# EasyEDA Pro project YanQi_Project.eprj, schematic PayloadBoard

## Sheets
1 电调主控: Create Date: 2023-04-20; Page Name: 电调主控; Project Name: YanXi_Project; Schematic Name: PayloadBoard; Update Date: 2023-08-07; Company: 嘉立创EDA; Drawed: WANG BIN; Page Size: A4; Version: V1.0
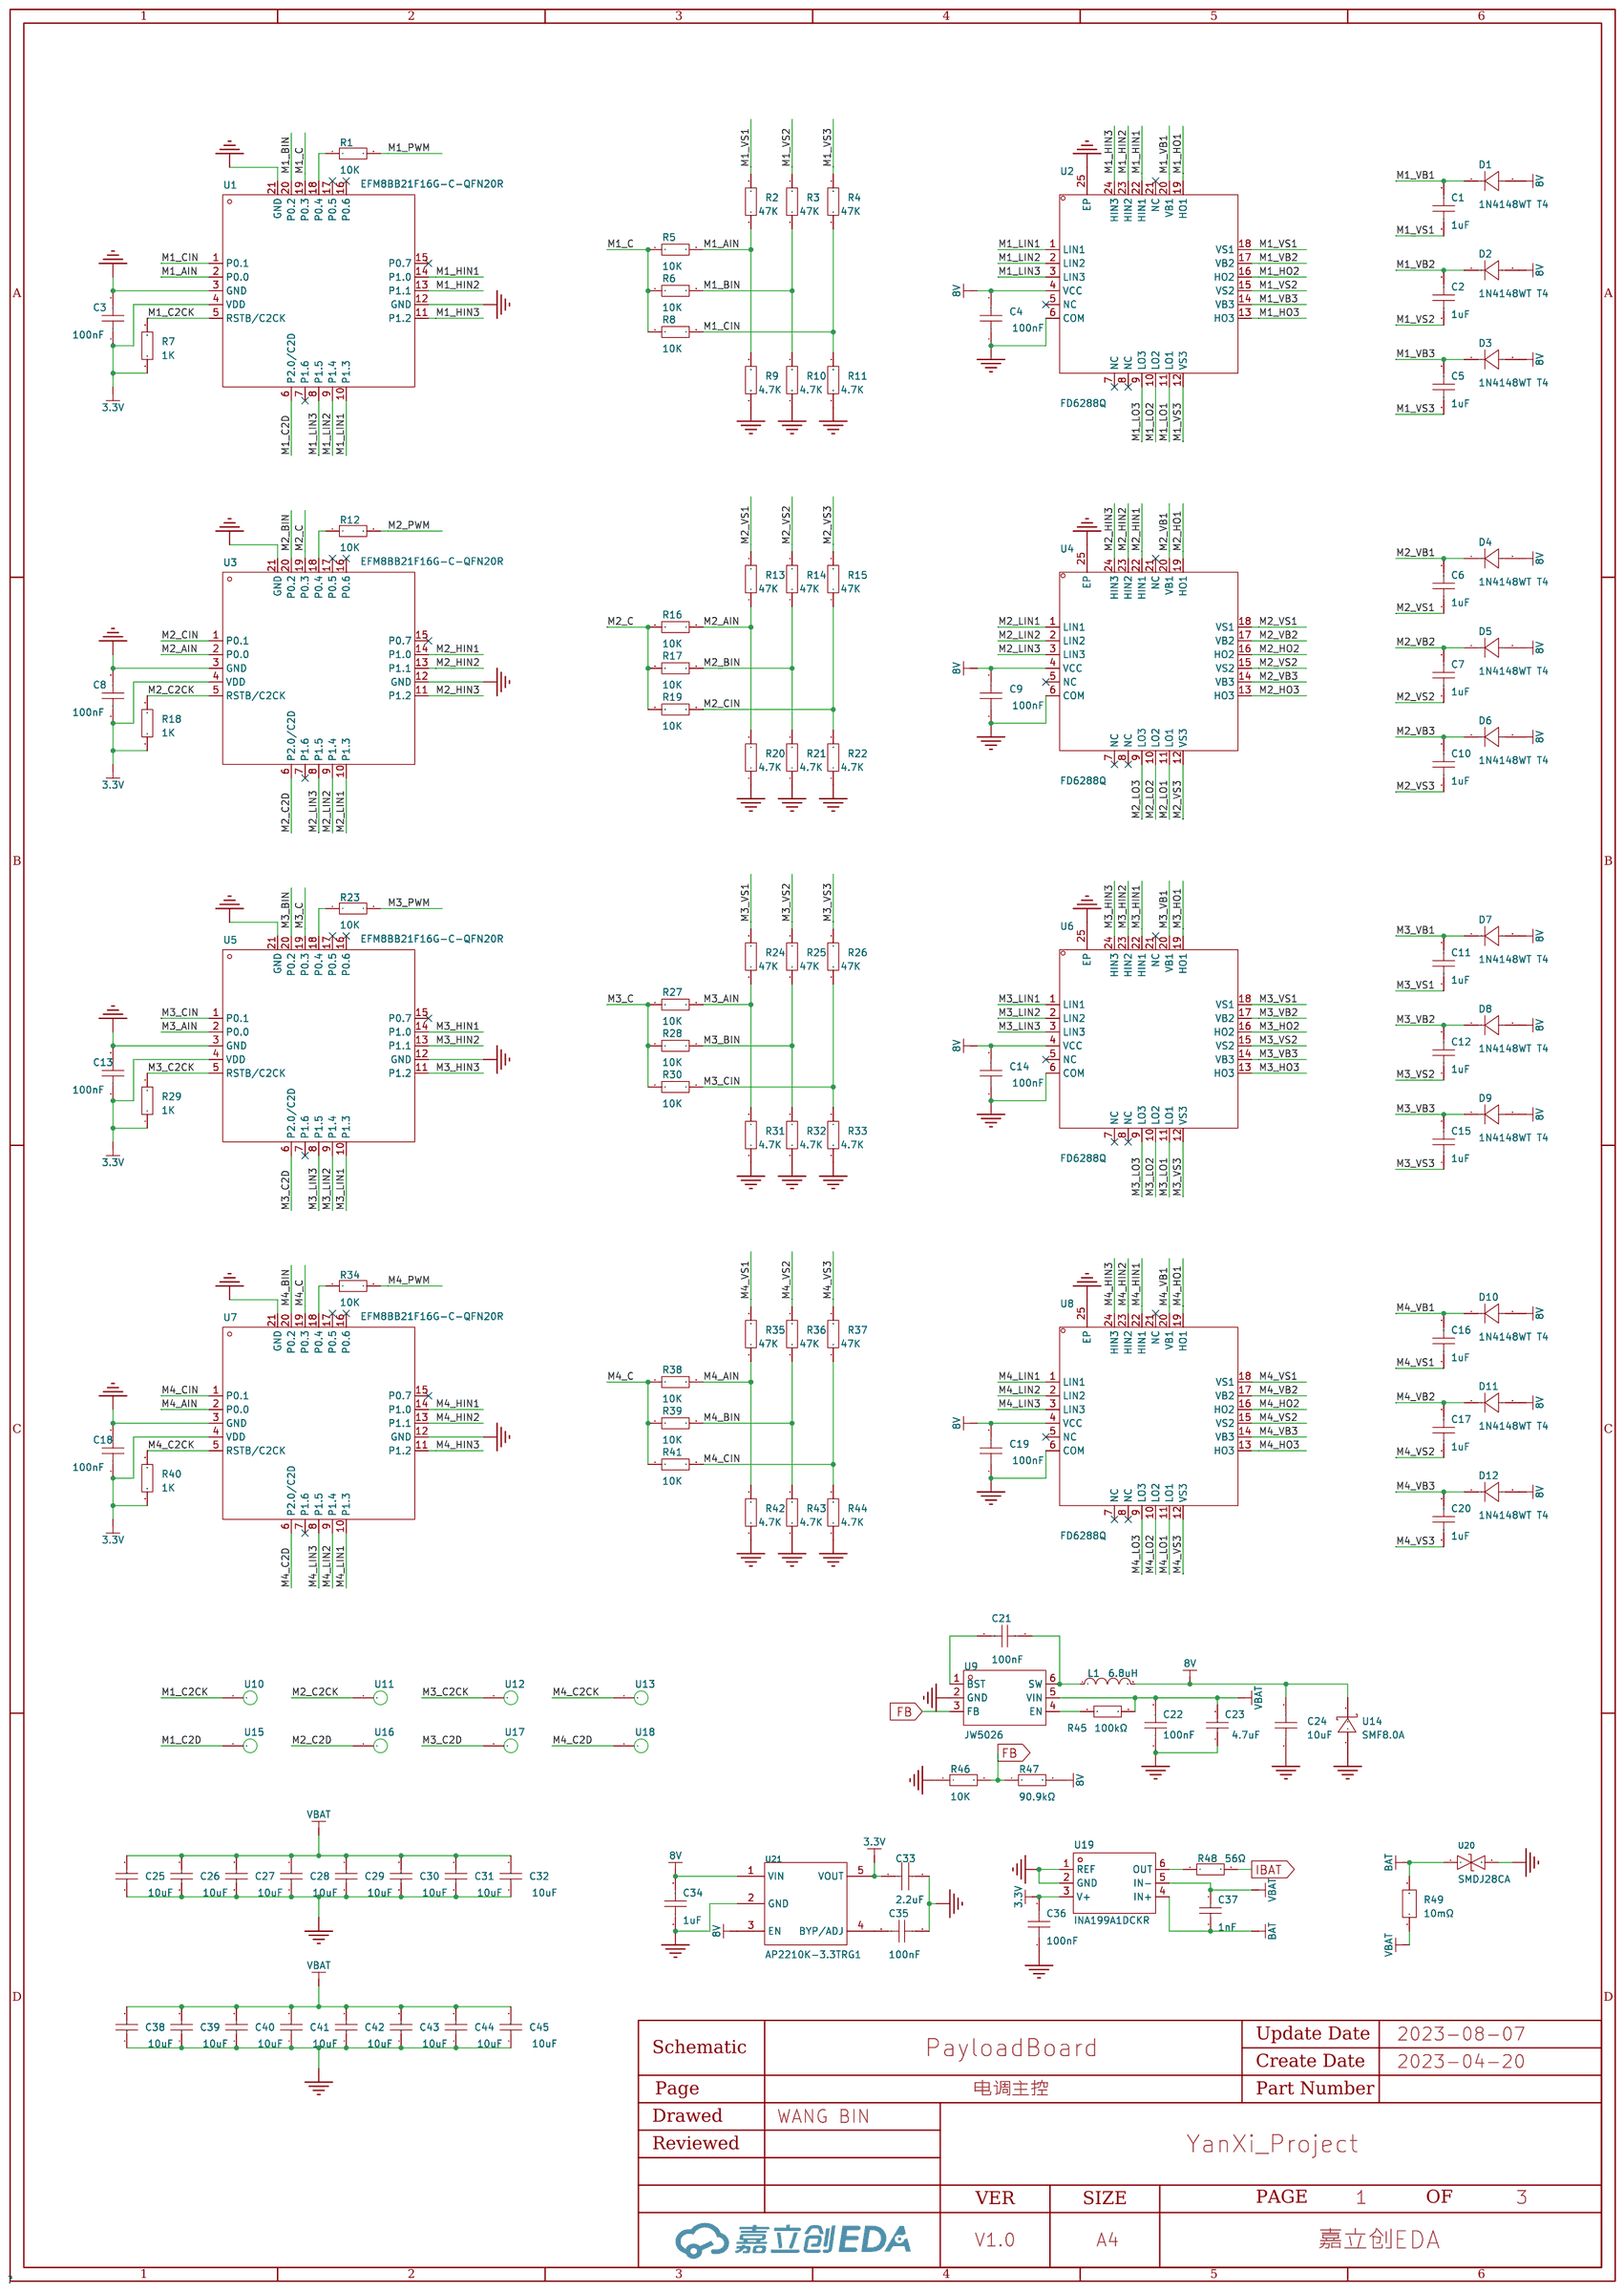
[diagram p0: 电调主控]
2 接插件: Page Name: 接插件; Update Date: 2023-08-08
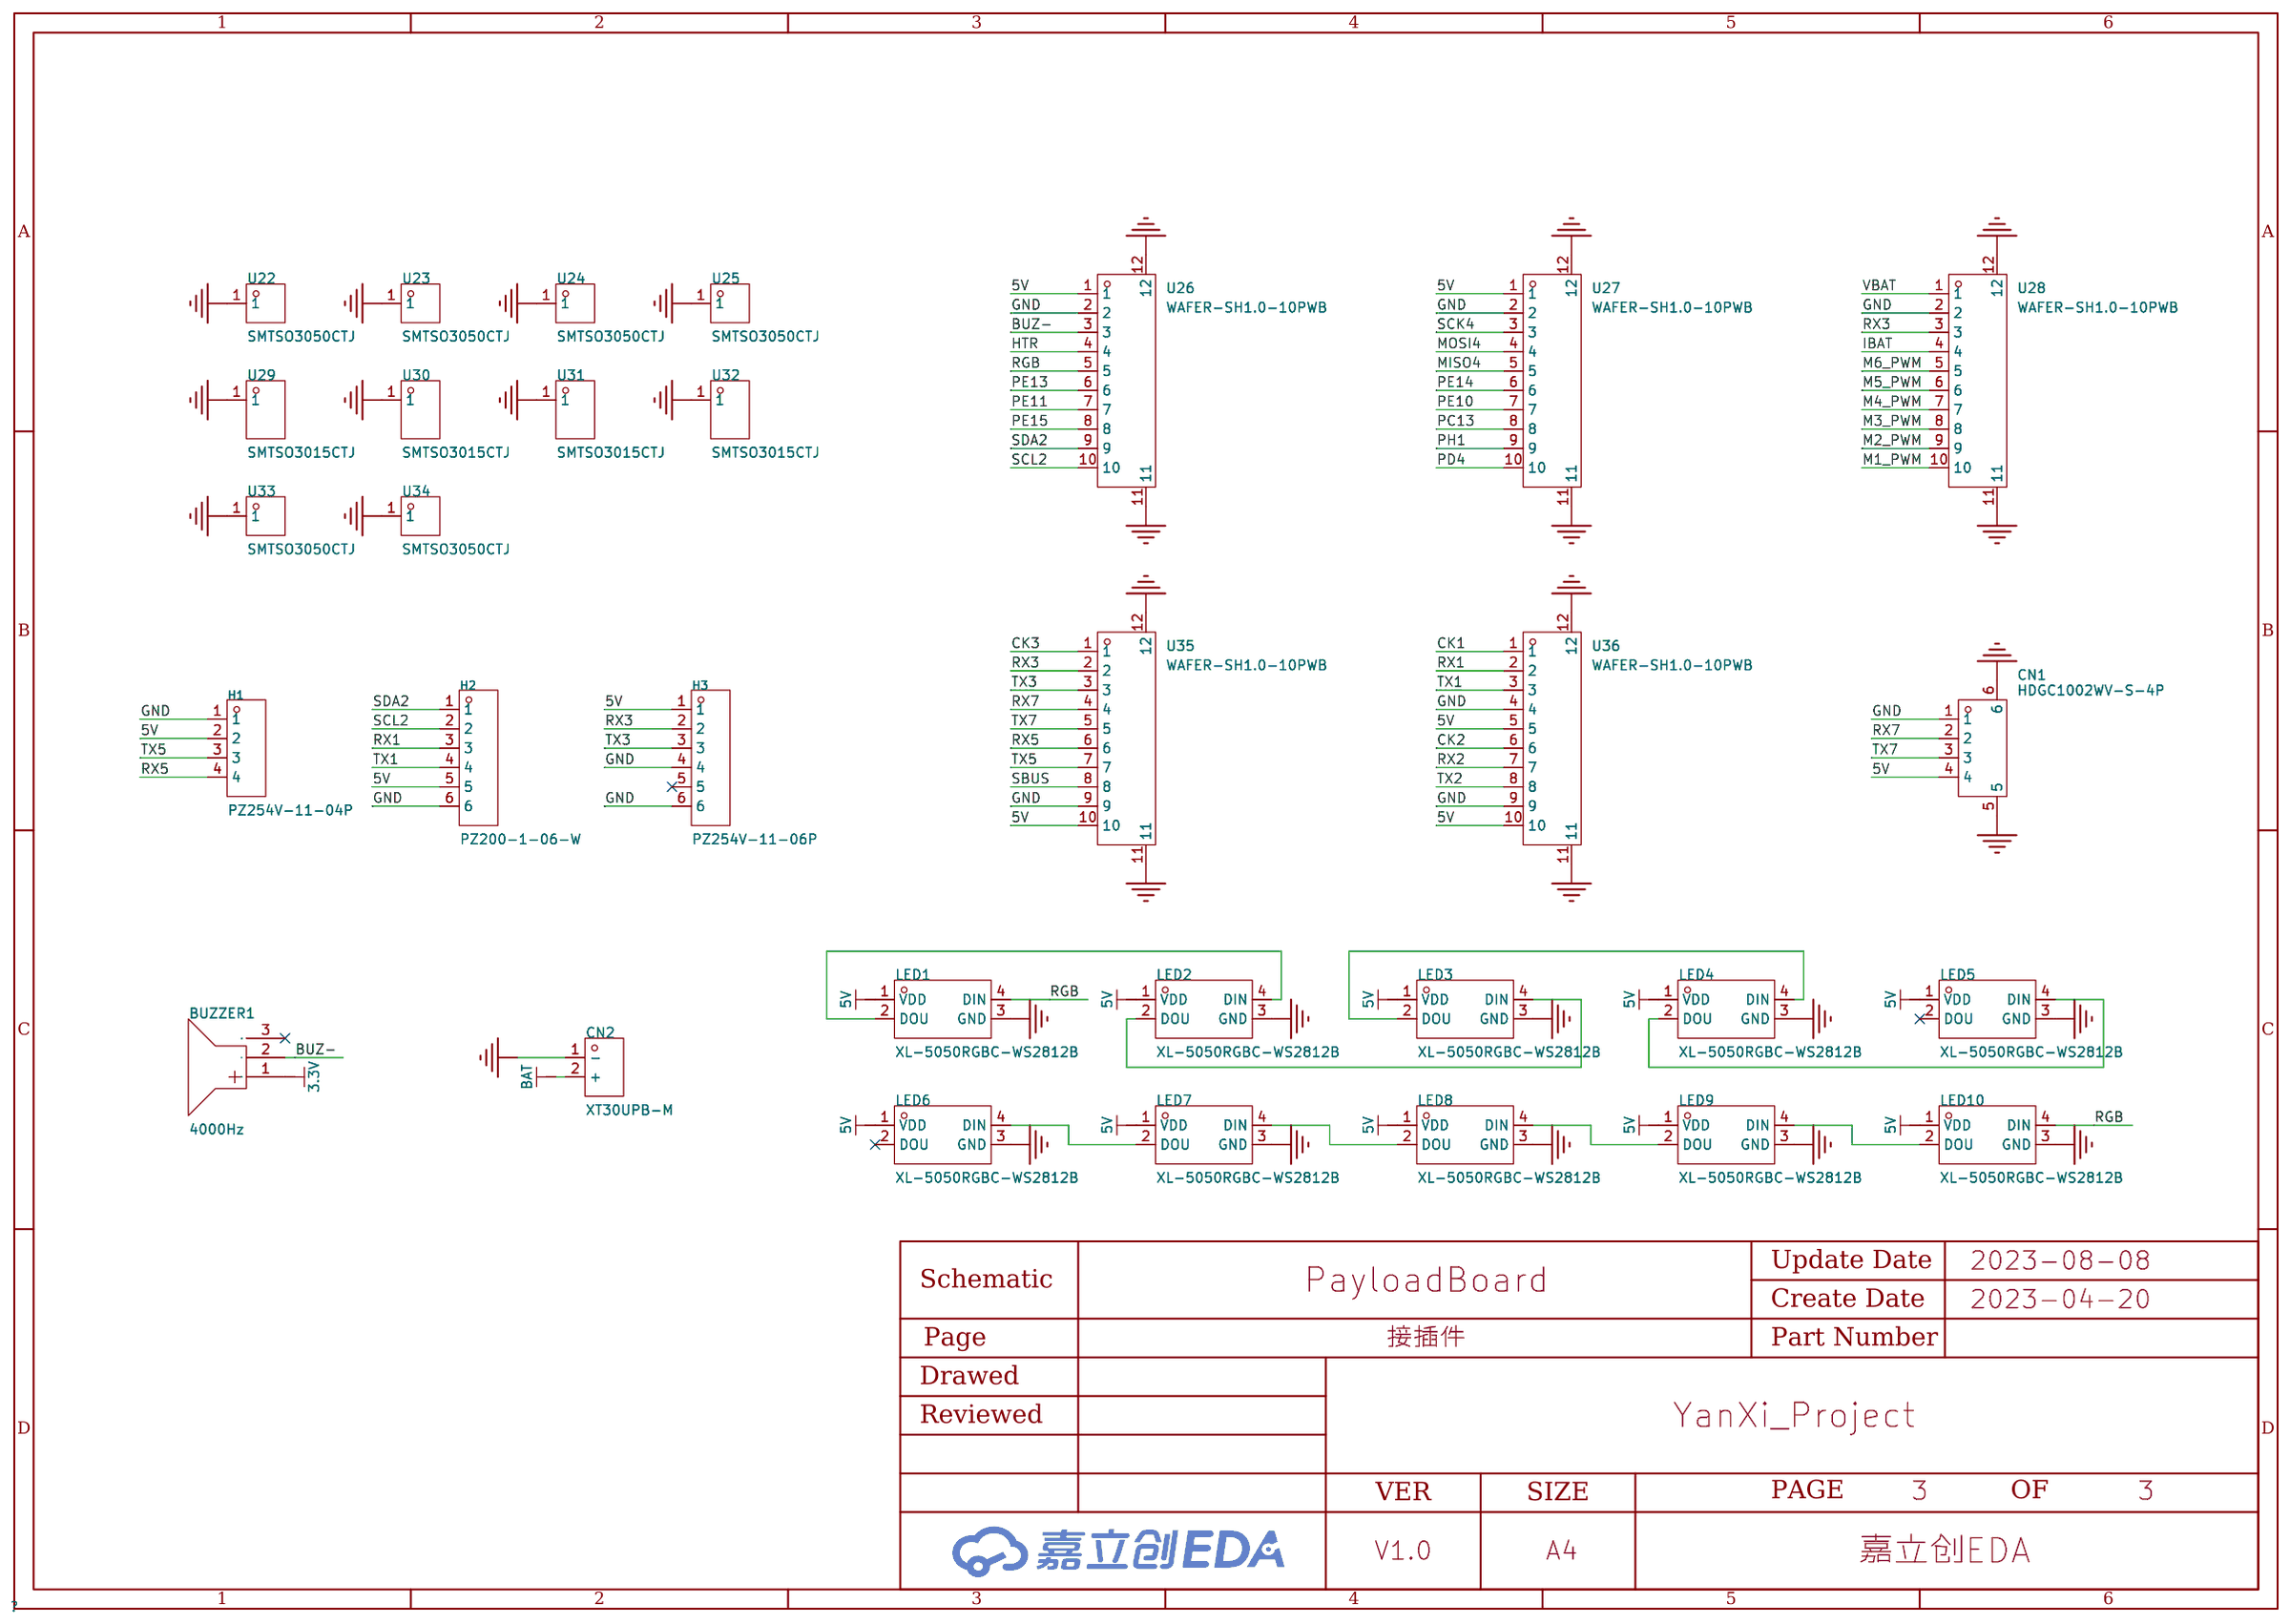
[diagram p1: 接插件]
3 电调驱动: Create Date: 2023-07-10; Page Name: 电调驱动
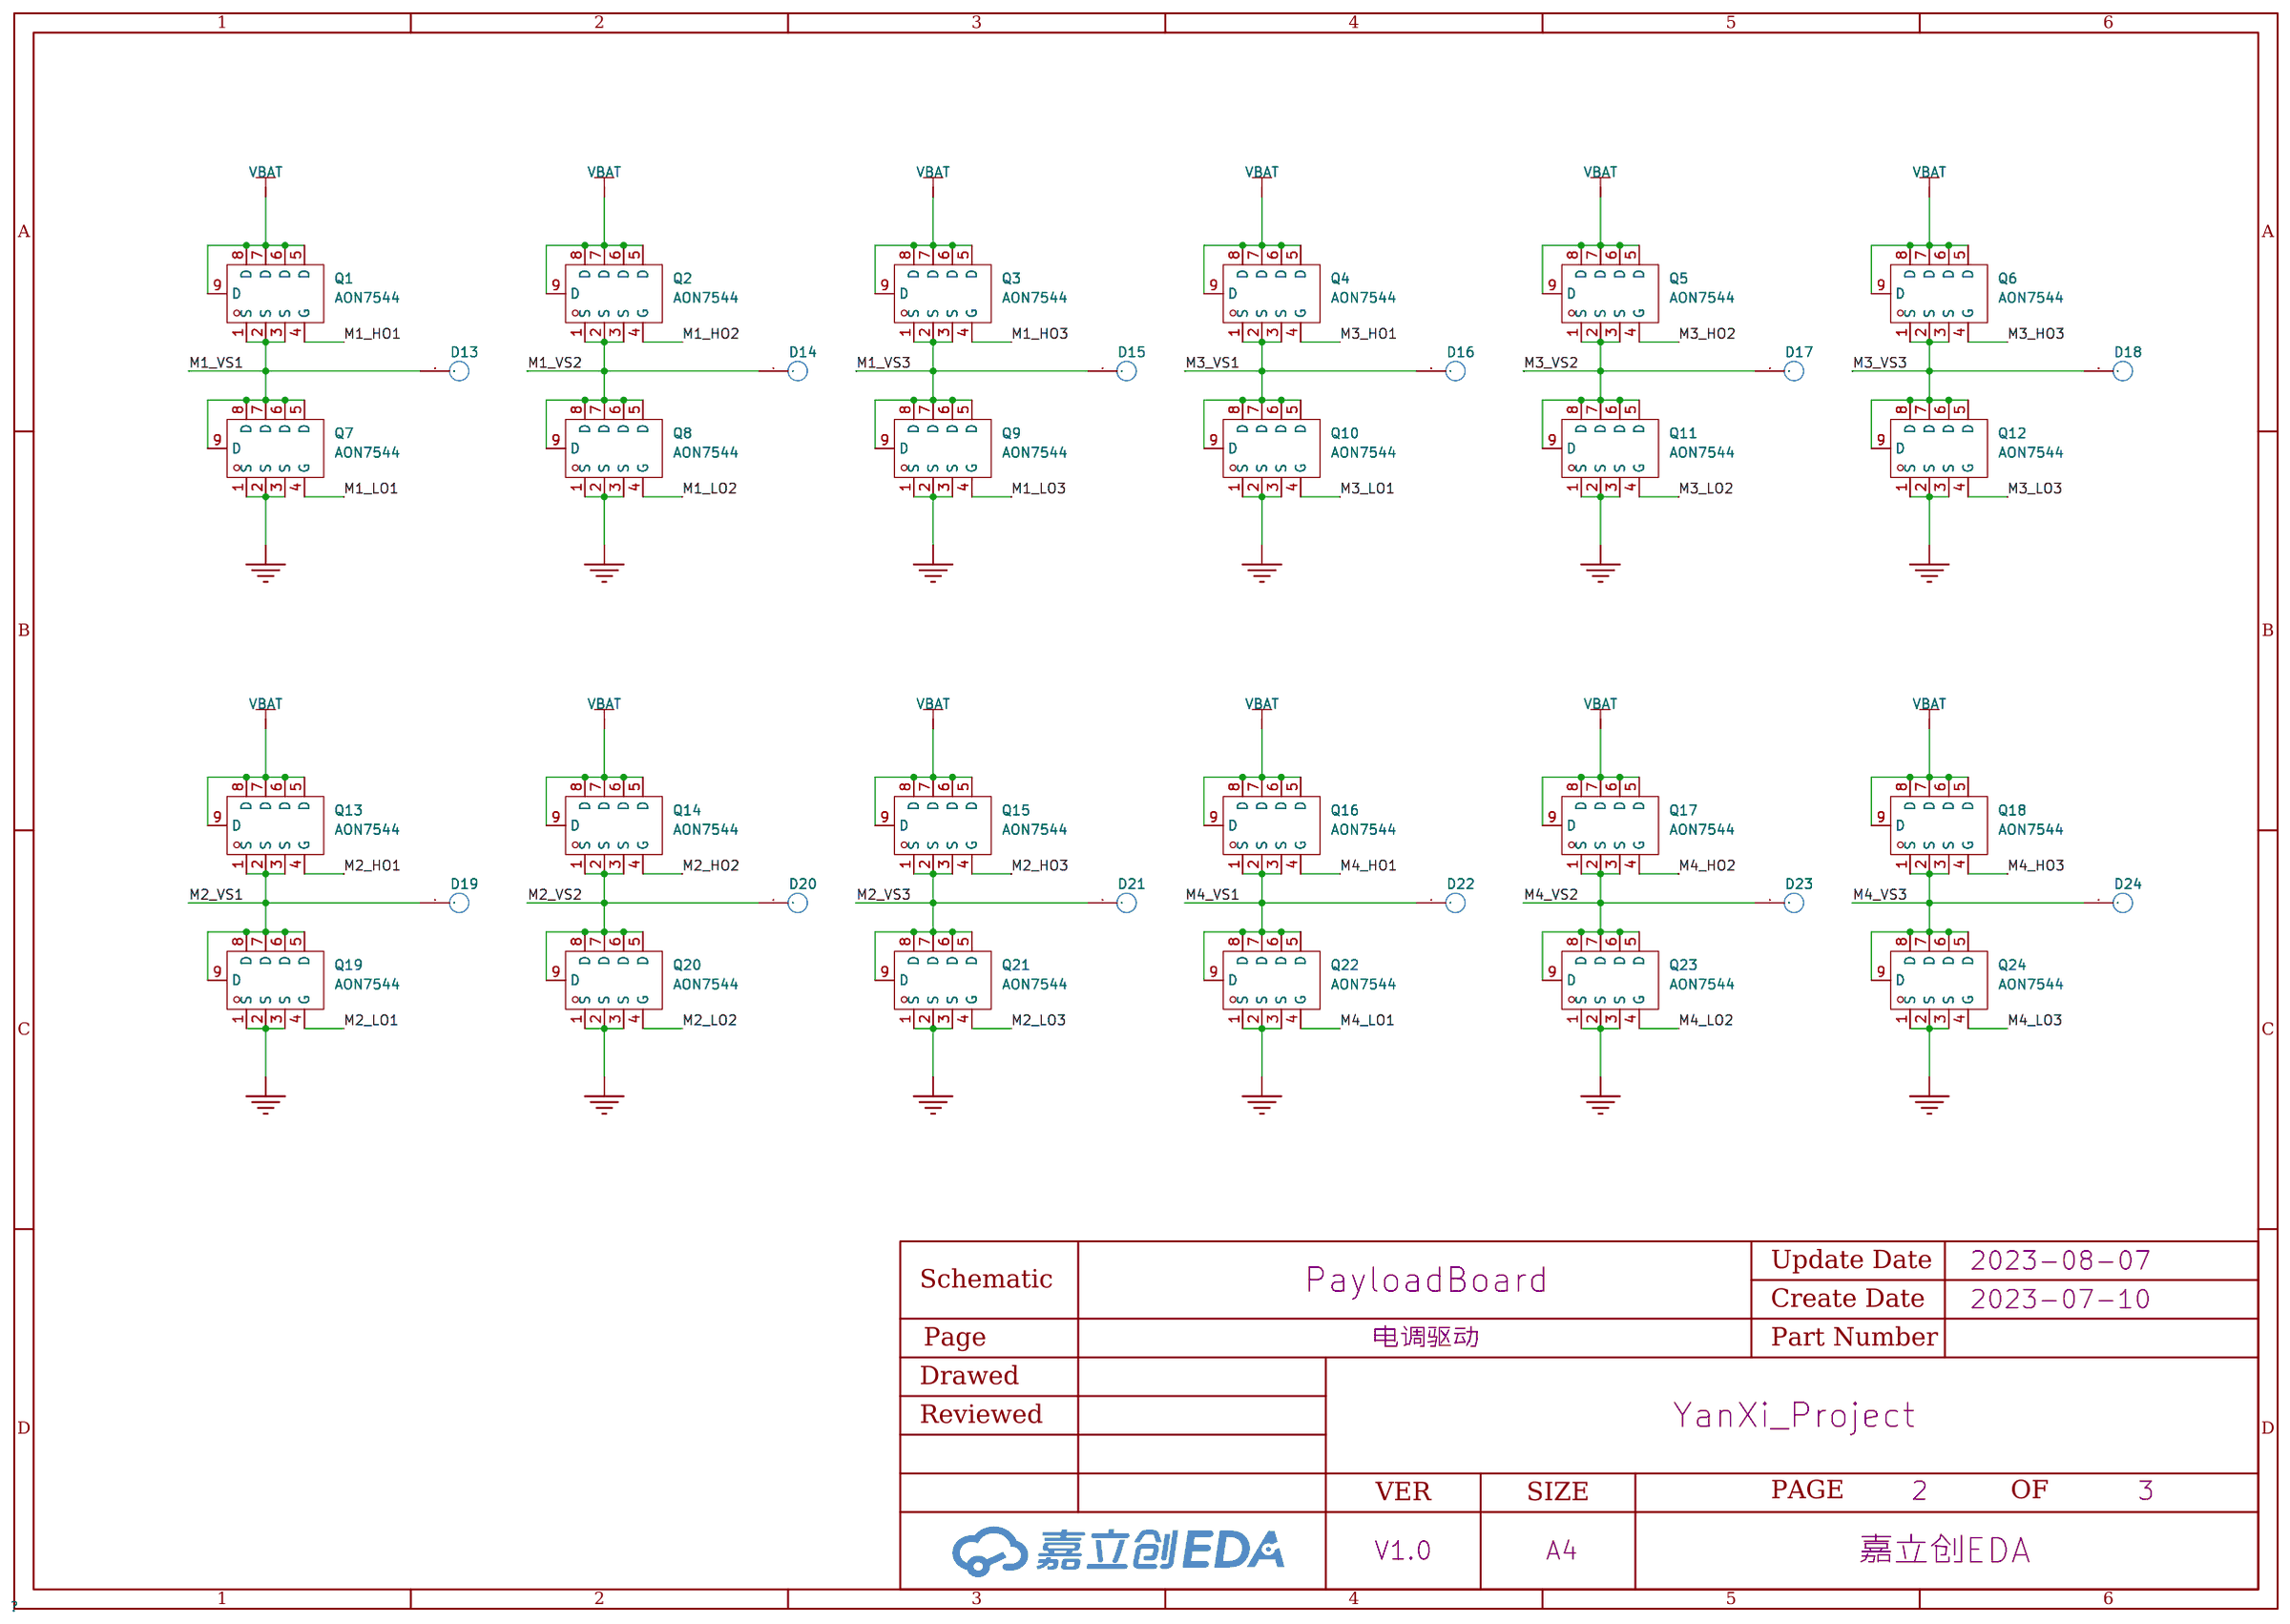
[diagram p2: 电调驱动]

## Parts
sheet 接插件
BUZZER1  4000Hz  [BUZ-SMD_4P-L5.0-W5.0-P4.00-BR]
CN1  HDGC1002WV-S-4P  [CONN-SMD_4P-P1.00_HDGC_HDGC1002WV-S-4P]
CN2  XT30UPB-M  [CONN-TH_XT30UPB-M]
H1  PZ254V-11-04P  [HDR-TH_4P-P2.54-V-M]
H2  PZ200-1-06-W  [HDR-TH_6P-P2.00-H-M-W7.2-N]
H3  PZ254V-11-06P  [HDR-TH_6P-P2.54-V-M]
LED1  XL-5050RGBC-WS2812B  [LED-SMD_4P-L5.0-W5.0-BL_XL-5050RGBC]
LED2  XL-5050RGBC-WS2812B  [LED-SMD_4P-L5.0-W5.0-BL_XL-5050RGBC]
LED3  XL-5050RGBC-WS2812B  [LED-SMD_4P-L5.0-W5.0-BL_XL-5050RGBC]
LED4  XL-5050RGBC-WS2812B  [LED-SMD_4P-L5.0-W5.0-BL_XL-5050RGBC]
LED5  XL-5050RGBC-WS2812B  [LED-SMD_4P-L5.0-W5.0-BL_XL-5050RGBC]
LED6  XL-5050RGBC-WS2812B  [LED-SMD_4P-L5.0-W5.0-BL_XL-5050RGBC]
LED7  XL-5050RGBC-WS2812B  [LED-SMD_4P-L5.0-W5.0-BL_XL-5050RGBC]
LED8  XL-5050RGBC-WS2812B  [LED-SMD_4P-L5.0-W5.0-BL_XL-5050RGBC]
LED9  XL-5050RGBC-WS2812B  [LED-SMD_4P-L5.0-W5.0-BL_XL-5050RGBC]
LED10  XL-5050RGBC-WS2812B  [LED-SMD_4P-L5.0-W5.0-BL_XL-5050RGBC]
U22  SMTSO3050CTJ  [SMD_SMTSO3060CTJ]
U23  SMTSO3050CTJ  [SMD_SMTSO3060CTJ]
U24  SMTSO3050CTJ  [SMD_SMTSO3060CTJ]
U25  SMTSO3050CTJ  [SMD_SMTSO3060CTJ]
U26  WAFER-SH1.0-10PWB  [CONN-SMD_10P-P1.00_WAFER-SH1.0-10PWB]
U27  WAFER-SH1.0-10PWB  [CONN-SMD_10P-P1.00_WAFER-SH1.0-10PWB]
U28  WAFER-SH1.0-10PWB  [CONN-SMD_10P-P1.00_WAFER-SH1.0-10PWB]
U29  SMTSO3015CTJ  [SMD_BD5.6-L5.6-W5.6-D4.1]
U30  SMTSO3015CTJ  [SMD_BD5.6-L5.6-W5.6-D4.1]
U31  SMTSO3015CTJ  [SMD_BD5.6-L5.6-W5.6-D4.1]
U32  SMTSO3015CTJ  [SMD_BD5.6-L5.6-W5.6-D4.1]
U33  SMTSO3050CTJ  [SMD_SMTSO3060CTJ]
U34  SMTSO3050CTJ  [SMD_SMTSO3060CTJ]
U35  WAFER-SH1.0-10PWB  [CONN-SMD_10P-P1.00_WAFER-SH1.0-10PWB]
U36  WAFER-SH1.0-10PWB  [CONN-SMD_10P-P1.00_WAFER-SH1.0-10PWB]
sheet 电调主控
C1  1uF  [C0402]
C2  1uF  [C0402]
C3  100nF  [C0402_NEW]
C4  100nF  [C0402_NEW]
C5  1uF  [C0402]
C6  1uF  [C0402]
C7  1uF  [C0402]
C8  100nF  [C0402_NEW]
C9  100nF  [C0402_NEW]
C10  1uF  [C0402]
C11  1uF  [C0402]
C12  1uF  [C0402]
C13  100nF  [C0402_NEW]
C14  100nF  [C0402_NEW]
C15  1uF  [C0402]
C16  1uF  [C0402]
C17  1uF  [C0402]
C18  100nF  [C0402_NEW]
C19  100nF  [C0402_NEW]
C20  1uF  [C0402]
C21  100nF  [C0402_NEW]
C22  100nF  [C0402_NEW]
C23  4.7uF  [C0603]
C24  10uF  [C0603]
C25  10uF  [C1206]
C26  10uF  [C1206]
C27  10uF  [C1206]
C28  10uF  [C1206]
C29  10uF  [C1206]
C30  10uF  [C1206]
C31  10uF  [C1206]
C32  10uF  [C1206]
C33  2.2uF  [C0402]
C34  1uF  [C0402]
C35  100nF  [C0402_NEW]
C36  100nF  [C0402_NEW]
C37  1nF  [C0402]
C38  10uF  [C1206]
C39  10uF  [C1206]
C40  10uF  [C1206]
C41  10uF  [C1206]
C42  10uF  [C1206]
C43  10uF  [C1206]
C44  10uF  [C1206]
C45  10uF  [C1206]
D1  1N4148WT T4  [SOD-523_L1.2-W0.8-LS1.6-RD]
D2  1N4148WT T4  [SOD-523_L1.2-W0.8-LS1.6-RD]
D3  1N4148WT T4  [SOD-523_L1.2-W0.8-LS1.6-RD]
D4  1N4148WT T4  [SOD-523_L1.2-W0.8-LS1.6-RD]
D5  1N4148WT T4  [SOD-523_L1.2-W0.8-LS1.6-RD]
D6  1N4148WT T4  [SOD-523_L1.2-W0.8-LS1.6-RD]
D7  1N4148WT T4  [SOD-523_L1.2-W0.8-LS1.6-RD]
D8  1N4148WT T4  [SOD-523_L1.2-W0.8-LS1.6-RD]
D9  1N4148WT T4  [SOD-523_L1.2-W0.8-LS1.6-RD]
D10  1N4148WT T4  [SOD-523_L1.2-W0.8-LS1.6-RD]
D11  1N4148WT T4  [SOD-523_L1.2-W0.8-LS1.6-RD]
D12  1N4148WT T4  [SOD-523_L1.2-W0.8-LS1.6-RD]
L1  6.8uH  [L0805]
R1  10K  [R0402]
R2  47K  [R0402]
R3  47K  [R0402]
R4  47K  [R0402]
R5  10K  [R0402]
R6  10K  [R0402]
R7  1K  [R0402]
R8  10K  [R0402]
R9  4.7K  [R0402]
R10  4.7K  [R0402]
R11  4.7K  [R0402]
R12  10K  [R0402]
R13  47K  [R0402]
R14  47K  [R0402]
R15  47K  [R0402]
R16  10K  [R0402]
R17  10K  [R0402]
R18  1K  [R0402]
R19  10K  [R0402]
R20  4.7K  [R0402]
R21  4.7K  [R0402]
R22  4.7K  [R0402]
R23  10K  [R0402]
R24  47K  [R0402]
R25  47K  [R0402]
R26  47K  [R0402]
R27  10K  [R0402]
R28  10K  [R0402]
R29  1K  [R0402]
R30  10K  [R0402]
R31  4.7K  [R0402]
R32  4.7K  [R0402]
R33  4.7K  [R0402]
R34  10K  [R0402]
R35  47K  [R0402]
R36  47K  [R0402]
R37  47K  [R0402]
R38  10K  [R0402]
R39  10K  [R0402]
R40  1K  [R0402]
R41  10K  [R0402]
R42  4.7K  [R0402]
R43  4.7K  [R0402]
R44  4.7K  [R0402]
R45  100kΩ  [R0402]
R46  10K  [R0402]
R47  90.9kΩ  [R0402]
R48  56Ω  [R0402]
R49  10mΩ  [R1225]
U1  EFM8BB21F16G-C-QFN20R  [QFN-20_L3.0-W3.0-P0.50-BL-EP1.7_EFM8BB21F16G]
U2  FD6288Q  [QFN-24_L4.0-W4.0-P0.50-BL-EP2.6]
U3  EFM8BB21F16G-C-QFN20R  [QFN-20_L3.0-W3.0-P0.50-BL-EP1.7_EFM8BB21F16G]
U4  FD6288Q  [QFN-24_L4.0-W4.0-P0.50-BL-EP2.6]
U5  EFM8BB21F16G-C-QFN20R  [QFN-20_L3.0-W3.0-P0.50-BL-EP1.7_EFM8BB21F16G]
U6  FD6288Q  [QFN-24_L4.0-W4.0-P0.50-BL-EP2.6]